# EasyEDA Pro project ProPrj_Starcat_FOC双路矢量控制器_2024-11-11.epro, board 双路大功率矢量控制器_3 (continued)
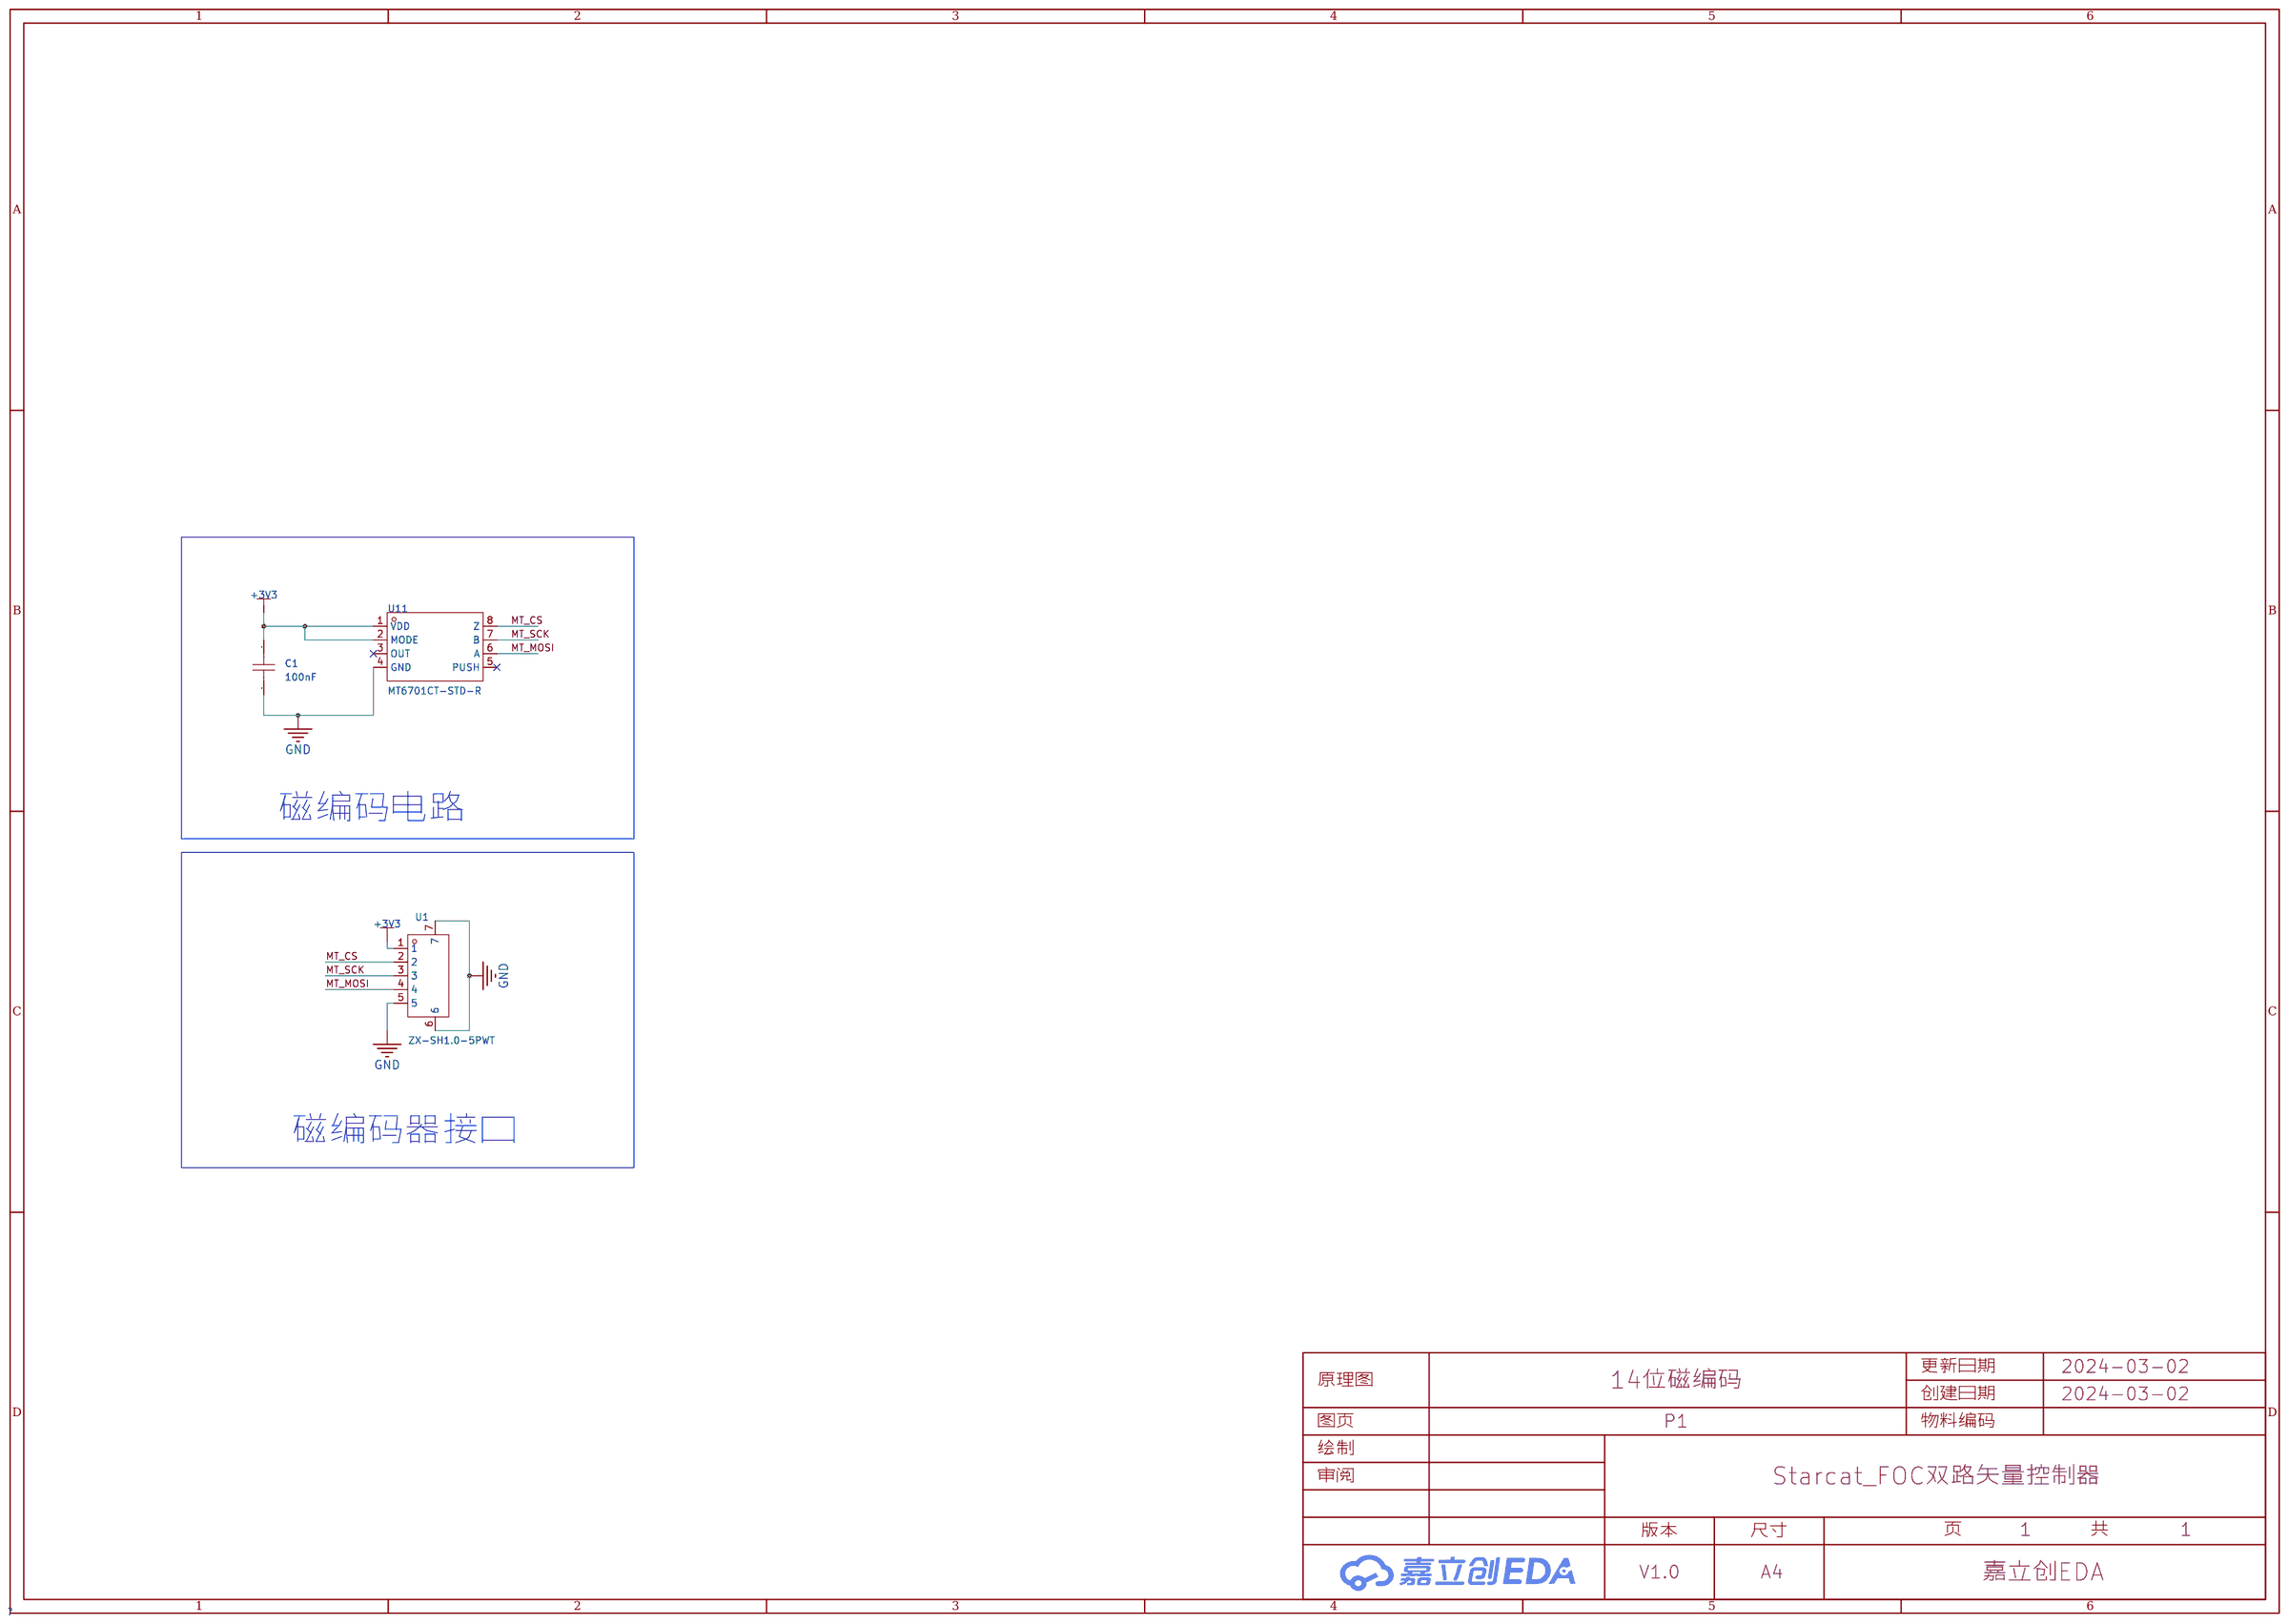
[diagram p0: schematic sheet]
## Routing (per net, layer and track width the routed paths; a pad name or vN(x,y) marks a point on that pad's centre or on a via; arc(x,y) is an arc through that point)
+3V3: length 368.2
  Top Layer w0.305: 48.6,42.16 48.34,42.16 47.75,41.57 v1(47.75,40.56) 47.5,40.3 U12.19 47.5,36.62 45.89,35.01 C10.1 ; 48.6,42.16 47.84,42.93 47.84,45.97 49.23,47.37 ; 48.6,42.16 49.23,42.16 49.61,41.78 52.23,41.78 52.45,41.57 52.45,40.85 52.79,40.51 53.68,40.51 54,40.2 U12.32 55.76,39.03 C8.1 ; C12.2 56,50.51 U12.48 53.56,48.53 52.41,47.37 49.23,47.37 ; C12.2 55.33,51.18 v1(54.82,51.18) ; C12.2 C9.1 57.74,49.97 v1(57.74,49.3) ; U12.1 v1(44.5,50.69) C11.1 44.87,50.53 U12.64 46.5,49.09 48.22,47.37 49.23,47.37 ; 49.74,54.6 49.74,54.99 49.36,55.37 v1(46.95,55.37) ; v1(77.72,9.94) 77.65,9.94 77.46,10.13 U11.1 ; v1(20.66,12.57) 20.66,13.09 U9.1 ; U16.49 32.24,41.93 32.6,42.29 v1(33.36,42.29) ; v1(75.65,43.49) 74.61,42.45 U15.49 74.61,39.65 77.55,36.7 79.21,36.7 80.97,34.94 80.97,32.57 81.28,32.27 84.87,32.27 85.17,32.57 85.17,33.52 v1(86.32,34.66) R1.2 ; v1(14.59,48.82) 14.59,51.59 16.52,53.51 C18.1 18.57,54.93 18.91,55.28 v1(19.9,55.28)
  Inner1 w0.305: v1(47.75,40.56) 46.57,39.37 45.3,39.37 43.67,40.99 33.77,40.99 33.36,41.4 v1(33.36,42.29) ; U11.1 77.46,14 79.59,16.13 79.59,16.53 81.62,18.56 81.62,27.81 80.98,28.45 80.22,28.45 79.08,29.59 79.08,31.88 v1(79.21,32) 79.84,32.64 81.62,32.64 81.83,32.85 81.83,36.23 81.24,36.83 76.41,36.83 75.65,37.59 v1(75.65,43.49)
  Inner2 w0.305: v1(46.95,55.37) 46.82,55.24 46.82,52.07 47.71,51.18 v1(54.82,51.18) ; v1(71.44,55.37) 71.44,49 70.67,48.23 58.81,48.23 v1(57.74,49.3) ; v1(77.72,9.94) 57.33,9.94 54.95,12.32 48.22,12.32 46.06,10.16 27.9,10.16 25.48,12.57 v1(20.66,12.57) ; v1(44.5,50.69) 43.75,51.43 33.49,51.43 32.34,52.58 v1(31.45,52.58) 31.33,52.58 30.95,52.96 30.95,54.61 30.28,55.28 v1(19.9,55.28)
  Bottom Layer w0.305: v1(77.72,9.94) 78.02,9.64 ; U4.5 21.55,54.99 21.13,55.41 21.01,55.28 v1(19.9,55.28) ; 80.48,9.66 R17.2 R16.2 ; R8.1 84.41,20.95 83.52,21.84 83.52,29.84 83.78,30.1 ; v1(54.82,51.18) 51.87,51.18 51.82,51.13 CN1.4 ; 83.78,30.1 86.83,30.1 87.33,29.59 87.33,27.68 R3.1 ; 83.78,30.1 83.52,30.35 83.52,31.32 82.58,32.26 79.46,32.26 v1(79.21,32) 78.63,31.43 72.79,31.43 72.09,32.13 72.09,34.16 72.34,34.41 C23.2 C22.1 ; v1(71.44,55.37) Q1.2 71.44,47.31 71.66,47.1 74.78,47.1 75.65,46.23 v1(75.65,43.49) U10.4 ; 85.96,20.95 85.96,17.46 86.57,16.85 87.35,16.85 87.57,16.63 87.57,15.86 87.52,15.81 ; CN2.4 14.59,46.48 v1(14.59,48.82) ; R14.2 24.86,9.53 25.23,9.91 ; 87.56,15.77 87.56,14.21 87.01,13.65 82.5,13.65 81.98,13.12 81.98,10.2 81.55,9.78 80.59,9.78 ; R12.2 20.66,10.3 v1(20.66,12.57)
  Bottom Layer w0.508: 21.64,9.53 23.67,9.53
  Bottom Layer w0.61: C5.2 68.38,51.72 68.92,51.18 71.12,51.18 Q1.2
+3V3_VDA: length 5.8
  Top Layer w0.305: U12.13 43.5,42.53 43.14,42.16 43.14,41.2 C3.1 41.68,39.74 L3.2
+3V3A: length 102.8
  Top Layer w0.305: v1(23.73,45.47) 23.73,46.73 24.19,47.18 24.19,48.02 U16.24 ; L3.1 38.95,39.8 C2.1 v1(37.55,39.55) 37.55,39.37 41.87,35.05 v1(41.87,33.53) ; R21.2 v1(67.01,30.23) ; 66.6,48.17 66.6,49.73 ; 66.78,49.89 v1(66.78,49.92)
  Inner1 w0.305: v1(56.35,33.65) 56.09,33.91 53.55,33.91 53.17,33.53 v1(41.87,33.53) 36.79,33.53 35.61,32.35 v1(35.61,30.23)
  Inner2 w0.305: v1(56.35,33.65) 65.87,33.65 67.01,32.52 v1(67.01,30.23) ; v1(23.73,45.47) 23.73,41.12 25.31,39.55 v1(37.55,39.55)
  Bottom Layer w0.305: 62.28,51.18 61.55,51.18 61,51.73 C6.2 ; 62.61,50.07 62.36,50.31 62.36,51.13 ; 62.61,50.07 62.35,49.82 v1(62.35,48.95) 61.16,47.75 57.49,47.75 54.31,44.58 54.31,34.16 54.69,33.78 56.22,33.78 v1(56.35,33.65) ; 62.61,50.07 62.79,49.88 66.73,49.88 ; 62.3,51.19 U1.5
+5V: length 173.9
  Top Layer w0.61: v1(68.41,50.55) 68.41,53.97 68.92,54.48 v1(73.62,54.48)
  Top Layer w0.762: 85.47,36.95 86.97,36.95 87.71,37.69 87.71,42.51 86.76,43.46 84.09,43.46 82.64,44.91 ; v1(80.56,47.44) 80.56,47.44 80.37,47.64 80.37,45.38 ; v1(49.18,11.21) 49.21,11.17 v1(49.21,10.31)
  Inner1 w0.762: v1(12.28,34.54) 12.28,18.16 20.53,9.91 48.81,9.91 v1(49.21,10.31) 49.21,10.47 49.48,10.73 ; 50.07,10.79 81.95,10.79 ; 81.95,10.79 82.35,11.19 ; 82.69,11.53 82.69,36.13 83.49,36.92 v1(85.44,36.92) 85.45,36.94 v1(86.31,36.94) ; v1(49.18,11.21) 49.6,10.79 49.91,10.79
  Bottom Layer w0.305: 73.16,54.44 Q1.3 ; L5.2 77.92,52.01 U6.4 ; v1(77.99,52.12) 78.82,52.96 78.82,53.59 79.14,53.91 U6.6
  Bottom Layer w0.61: v1(80.56,47.44) 78.91,47.44 77.99,48.36 v1(77.99,52.12) ; U1.1 62.38,53.02 62.57,52.83 63.97,52.83 64.28,53.15 U1.3 64.36,53.8 65.27,53.8 65.34,53.74 65.43,53.74 C1.2 67.18,53.19 67.39,52.98 67.39,51.56 v1(68.41,50.55) ; 73.24,54.36 73.37,54.48 v1(73.62,54.48) 75.45,54.48 C19.2 76.2,54.57 76.54,54.23 76.54,52.83 77.25,52.12 L5.2
  Bottom Layer w0.762: v1(12.28,34.54) D1.2
+9V: length 13.1
  Bottom Layer w0.305: 81.14,50.54 81.14,49.56 81,49.42 ; R11.2 82.16,50.61 C21.2 81.07,51.36 81.11,51.4 81.11,52.7 80.86,52.96 U6.5 ; 81.05,49.3 81.05,48.15 81.38,47.82 81.38,45.67 80.62,44.91 78.06,44.91 U10.2
AGND: length 581.7
  Top Layer w0.305: v1(41.74,55.5) 45.68,55.5 46.58,54.6 48.73,54.6 ; U11.5 81.46,10.83 U11.6 ; U16.28 22.24,48.33 19.94,50.63 C17.1 19.97,52.47 C18.2 20.09,53.64 ; v1(60.79,54.61) 59.27,54.61 58.89,54.23 C14.1 58.83,52.07 C9.2 C12.1 55.85,54.35 v1(54.82,55.37) ; 67.14,52.26 67.14,53.25 C66.1 v1(67.38,54.61) ; 85.3,47.5 85.3,51.56 84.55,52.32 84.03,52.32 ; U9.5 24.65,10.23 25.81,9.08 v1(25.81,9.03) 25.11,9.03 24.85,8.76 20.66,8.76 19.73,9.7 v1(19.55,9.7) ; 85.43,35.81 87.71,35.81 88.09,35.44 ; 85.43,35.81 85.43,35.94 84.67,36.7 84.67,37.46 v1(83.14,38.99) C47.2 ; 85.43,35.81 85.17,35.56 85.17,34.81 C49.1 ; 78.82,53.21 77.3,53.21 76.92,52.83 R31.2 ; 78.82,53.21 84.03,53.21 v1(84.16,53.09) 84.16,52.44 84.03,52.32 ; 78.82,53.21 79.24,52.79 R29.1 80.28,52.32 C46.1 ; v1(41.74,50.77) 41.74,49.61 C15.2 41.66,49.66 37.17,49.66 36.66,49.15 36.66,42.93 37.04,42.54 39.06,42.54 ; 29.68,52.26 29.99,51.94 33.58,51.94 R30.2 33.75,53.46 ; 35.24,42.16 36.54,42.16 37.5,41.2 C2.2 37.56,41.21 L4.1 39.06,41.3 39.06,42.54 ; 35.24,42.16 34.13,43.27 v1(31.28,43.27) ; 35.24,42.16 U16.55 ; 84.03,52.32 83.92,52.21 82.93,52.21 ; U12.18 47,36.88 44.92,34.8 44.92,33.4 45.3,33.02 45.83,33.02 C10.2 C36.1 47.03,33.08 R25.1 48.3,32.05 48.73,31.62 50.5,31.62 50.84,31.96 C34.1 51.59,33.08 51.6,33.08 R23.1 R24.1 ; 24.44,55.4 28.76,55.4 29.55,54.61 C56.1 ; 24.44,55.4 21,55.4 v1(20.09,54.48) 20.09,54.47 20.09,53.64 ; 24.44,55.4 24.91,54.93 C67.1 24.91,52.45 C63.2 ; 20.09,53.64 20.09,53.47 C73.1 21.14,53.3 C69.1 ; U15.28 64.21,47.95 62.33,49.83 62.33,51.86 62.73,52.26 63.44,52.26 63.44,53.47 C70.1 ; 33.75,53.46 33.49,53.72 v1(32,53.72) ; 33.75,53.46 33.87,53.34 41.1,53.34 42.24,52.19 C11.2 45.36,52.19 45.36,52.2 46.69,52.2 47,51.89 U12.63 ; C48.2 83.44,33.08 83.65,33.29 v1(83.65,33.63) ; 12.49,35.94 12.49,35.86 13.8,34.56 13.8,32.56 14.11,32.26 v1(16.59,32.26) ; v1(56.39,39.8) 57.54,39.8 C13.1 ; 39.06,42.54 41.17,42.54 C16.2
  Top Layer w0.61: R31.2 76.28,52.96 v1(75.65,52.96) 75.58,53.02 C54.1 ; 19.07,39.25 23.09,43.27 v1(26.71,43.27) ; 19.07,39.25 v1(19.07,41.11) 17.75,41.11 ; 19.07,39.25 19.07,36.64 16.59,34.16 v1(16.59,32.26) ; 17.78,47.5 19.15,47.5 v1(19.16,47.51) ; LED1.1 88.09,35.72 88.73,36.36 88.73,43.43 86.68,45.48 v1(85.67,45.48) 85.67,47.13 85.05,47.75 C51.1
  Top Layer w0.762: 20.4,32.3 20.4,33.06 C74.2 ; 20.4,32.3 20.36,32.26 v1(19.01,32.26) v1(18.37,32.26) ; 20.4,32.3 L1.1
  Inner1 w0.305: v1(83.14,38.99) 77.68,38.99 76.92,39.75 76.92,43.81 76.16,44.58 75.27,44.58 74.89,44.2 74.89,40.89 73.74,39.75 56.44,39.75 v1(56.39,39.8) 56.39,36.15 58.64,33.9 v1(58.64,33) v1(54.65,33) ; v1(60.79,54.61) 60.79,53.85 60.41,53.47 56.73,53.47 v1(54.82,55.37) 54.69,55.5 52.03,55.5 50.25,53.72 42.38,53.72 41.74,54.36 v1(41.74,55.5) 32.72,55.5 32.09,54.86 32.09,53.81 v1(32,53.72) ; v1(67.38,54.61) 67.38,53.87 67.88,53.37 75.24,53.37 v1(75.65,52.96) ; v1(84.16,53.09) 84,52.93 79.77,52.93 79.23,52.38 79.23,48.7
  Inner1 w0.61: v1(20.09,54.48) 18.88,53.28 18.88,47.78 v1(19.16,47.51) ; v1(73.62,45.21) 73.89,45.48 v1(85.67,45.48)
  Inner1 w0.762: v1(83.65,33.63) 83.65,10.79 v1(82.56,9.7) 81.9,9.04 v1(76.3,9.04) 76.28,9.02 v1(51.66,9.02) 25.81,9.02 v1(25.81,9.03) ; 51.65,9.07 51.65,9.63
  Inner2 w0.305: v1(60.79,54.61) 62.82,54.61 63.2,54.23 v1(63.2,49.02)
  Inner2 w0.61: v1(19.16,47.51) 19.16,41.2 v1(19.07,41.11)
  Bottom Layer w0.305: v1(60.79,54.61) 60.92,54.48 C6.1 61.3,54.48 61.81,54.99 63.58,54.99 ; v1(20.09,54.48) 20.15,54.42 20.15,54.1 19.77,53.72 U4.3 ; 11.85,44.84 CN2.5 ; 11.85,44.84 11.87,44.82 CN2.3 ; 11.85,44.84 CN2.6 ; 15.71,44.92 15.78,44.85 16.32,44.85 16.64,45.17 16.64,45.99 16.26,46.38 15.83,46.38 15.48,46.73 15.48,51.59 17.72,53.83 17.92,53.83 ; SW1.2 89.75,24.23 89.75,26.98 89.01,27.72 NRST.2 89.01,31.29 86.67,33.63 v1(83.65,33.63) 82.92,32.9 R19.1 76.06,32.9 75.95,33.01 C22.2 C23.1 ; v1(16.59,32.26) v1(18.37,32.26) ; 79.67,49.45 79.72,49.5 79.72,50.61 ; 75.52,53.15 75.52,53.15 C4.1 ; v1(58.64,33) 58.64,35.31 61.22,37.89 U10.12 ; U10.5 74.26,42.79 v1(73.62,43.43) ; R15.1 86.29,50.66 84.16,52.79 v1(84.16,53.09) 82.39,53.09 U6.2 ; CN1.1 45.73,51.13 45.3,51.56 42.53,51.56 v1(41.74,50.77) v1(41.74,55.5) ; 88.9,18.33 88.92,18.35 88.98,24.26 88.48,24.76 85.17,24.76 84.86,25.08 C7.1 ; Q1.1 69.58,54.57 C5.1 68.36,54.59 C1.1 65.58,54.99 63.58,54.99 ; 88.99,18.29 88.99,14.67 87.43,13.11 82.94,13.11 82.58,12.75 82.58,9.72 ; 63.58,54.99 63.33,54.74 U1.2 ; 79.67,49.19 79.13,48.65 79.06,48.65
  Bottom Layer w0.61: C19.1 75.52,53.15
  vias: v1(26.71,45.26) v1(26.71,44.33) v1(27.47,45.26) v1(27.47,44.33) v1(27.47,43.27) v1(28.24,45.26) v1(28.24,44.33) v1(28.24,43.27) v1(29,45.26) v1(29,44.33) v1(29,43.27) v1(29.76,45.26) v1(29.76,44.33) v1(29.76,43.27) v1(30.52,45.26) v1(30.52,44.33) v1(30.52,43.27) v1(31.28,45.26) v1(31.28,44.33) v1(51.67,9.65) v1(69.05,45.21) v1(69.04,44.34) v1(69.05,43.43) v1(69.8,45.21) v1(69.8,44.34) v1(69.81,43.43) v1(70.57,45.21) v1(70.57,44.34) v1(70.57,43.43) v1(71.33,45.21) v1(71.32,44.34) v1(71.33,43.43) v1(72.09,45.21) v1(72.09,43.43) v1(72.1,44.34) v1(72.85,45.21) v1(72.86,44.34) v1(72.85,43.43) v1(73.63,44.34) v1(79.16,48.59) v1(83.72,47.75)
GND_VDA: length 5.2
  Top Layer w0.305: L4.2 41.73,41.21 C3.2 42.63,42.09 42.63,42.67 42.98,43.03 U12.12
PGND: length 211.4
  Top Layer w0.305: v1(24.99,31.89) 24.99,32.82 C65.1 24.66,33.08 23.96,33.78 23.96,35.18 23.74,35.4 U16.32 ; v1(22.07,31.88) 22.07,32.88 21.3,33.65 21.3,35.05 ; U16.30 22.74,36.5 21.33,35.09 ; U15.32 66.11,38.46 62.44,34.8 62.44,33.4 62.76,33.08 C64.1 v1(63.46,32.13) ; U15.30 65.11,40.53 65.11,38.99 62.06,35.94 60.28,35.94 59.52,35.18 59.52,33.4 59.84,33.08 C72.1 v1(60.29,32.13) ; U16.44 29.74,38.8 31.07,37.46 34.12,37.46 36.5,35.08 v1(36.5,32.26) ; v1(75.97,32.13) 75.97,34.99 72.11,38.85 U15.44
  Top Layer w0.762: 16.34,20.19 19.64,20.19 20.4,20.95 20.4,22.96
  Inner1 w0.305: v1(25,18.15) 21.94,18.15 21.17,18.92 21.17,30.83 22.07,31.73 v1(22.07,31.88) ; v1(63.77,18.23) 60.59,18.23 59.77,19.05 59.77,24.13 61.4,25.75 61.4,30.45 62.31,31.37 63.2,31.37 63.46,31.62 v1(63.46,32.13) ; v1(75.97,32.13) 75.97,31.43 76.92,30.48 76.92,23.75 76.21,23.04 v1(72.68,23.04) ; v1(54.19,18.03) 53.76,18.03 52.89,18.9 50.97,18.9 50.35,19.52 50.35,30.58 51.52,31.75 59.91,31.75 v1(60.29,32.13) ; v1(24.99,31.89) 24.99,31.1 25.99,30.1 28.61,30.1 28.91,29.79 28.91,19.43 30.08,18.26 34.26,18.26 v1(34.37,18.15) ; v1(41.71,23) 41.74,23.04 41.74,32 41,32.74 36.81,32.74 36.5,32.44 v1(36.5,32.26)
  Bottom Layer w0.305: v1(54.19,18.03) 55.71,19.56 R53.1 ; v1(63.77,18.23) 65.1,19.56 R52.1 ; R54.1 37.42,19.68 35.88,18.15 v1(34.37,18.15) ; R55.1 26.41,19.68 25.66,18.93 25.66,18.85 25.3,18.49 25.3,18.45 v1(25,18.15)
  Bottom Layer w0.762: 10.12,21.21 10.63,21.72 C33.1 14.6,21.72 CN3.1
  vias: v1(41.74,21.91) v1(41.8,20.64) v1(42.06,22.46) v1(42.01,21.32) v1(42.14,20.04) v1(42.36,23.02) v1(42.43,21.91) v1(42.47,20.65) v1(42.64,21.33) v1(42.7,22.48) v1(42.83,20.01) v1(42.99,23.02) v1(43.09,21.89) v1(43.12,20.63) v1(43.28,21.27) v1(43.35,22.48) v1(43.55,20.03) v1(43.64,23.03) v1(43.71,21.88) v1(43.8,20.62) v1(43.95,22.49) v1(43.92,21.26) v1(70.75,23.02) v1(70.78,21.93) v1(70.84,20.65) v1(71.05,21.33) v1(71.1,22.48) v1(71.18,20.05) v1(71.4,23.03) v1(71.47,21.93) v1(71.51,20.66) v1(71.68,21.34) v1(71.74,22.49) v1(71.87,20.02) v1(72.04,23.03) v1(72.13,21.9) v1(72.16,20.64) v1(72.39,22.49) v1(72.32,21.28) v1(72.59,20.04) v1(72.75,21.89) v1(72.84,20.63) v1(72.96,21.27) v1(73,22.5)
VBUS_5V: length 20.4
  Top Layer w0.61: 17.75,41.92 20.12,41.92 v1(20.13,41.94) ; 17.81,46.68 20.12,46.68 v1(20.13,46.69)
  Bottom Layer w0.61: v1(12.61,37.21) 14.26,38.86 19.39,38.86 20.15,39.62 20.15,46.74
AH_1: length 20
  Top Layer w0.305: v1(69.97,49.66) 69.97,49.62 70.11,49.49 U15.17 ; v1(59.64,43.78) 58.4,45.03 U12.41
  Inner1 w0.305: v1(69.97,49.66) 69.97,47.54 69.68,47.24 62.95,47.24 59.64,43.94 v1(59.64,43.78)
AH_2: length 34
  Top Layer w0.305: v1(33.23,43.88) 33.23,46.35 32.85,46.74 27.9,46.74 27.74,46.89 U16.17 ; U12.37 53.07,43.03 52.79,43.31 50.37,43.31 v1(50.24,43.18)
  Bottom Layer w0.305: v1(50.24,43.18) 48.5,41.44 35.67,41.44 v1(33.23,43.88)
AL_1: length 16.9
  Top Layer w0.305: U15.18 69.61,46.91 68.92,46.23 68.1,46.23 67.72,45.85 64.22,45.85 59.9,41.53 57.3,41.53 57.3,41.53 U12.34
AL_2: length 32.4
  Top Layer w0.305: U16.18 27.24,49.04 v1(26.88,49.4) ; v1(48.65,40.59) 49.28,40.59 49.45,40.42 49.45,39.07 U12.23
  Inner2 w0.305: v1(48.65,40.59) 48.65,40.84 48.22,41.27 35.26,41.27 34.12,42.42 34.12,46.74 33.87,46.99 28.41,46.99 27.17,48.22 27.17,49.11 v1(26.88,49.4)
AO_1: length 17.2
  Top Layer w0.305: 77.92,33.86 79.36,33.86 79.94,33.27 79.94,33.2 ; 77.92,33.86 77.89,33.86 77.64,34.1 77.64,35.09 77.43,35.31 77.05,35.31 73.11,39.25 U15.46 ; 77.92,33.86 77.92,33.86 77.92,33.87 ; C52.2 80.1,31.76 79.08,30.73 79.08,27.56
AO_2: length 27.8
  Top Layer w0.305: U16.46 30.74,39.12 31.47,38.39 34.97,38.39 38.12,35.24 38.12,34.04 38.28,33.88 40.04,33.88 40.49,33.43 ; 50.63,27.43 50.63,29.21 49.11,30.73 43.12,30.73 40.66,33.19 C53.2
BH_1: length 18.2
  Top Layer w0.305: U12.42 58.76,45.53 v1(59.56,44.72) ; v1(69.15,49.64) 69.11,49.6 U15.19
  Inner1 w0.305: v1(59.56,44.72) 59.66,44.72 62.7,47.75 68.92,47.75 69.15,47.99 v1(69.15,49.64)
BH_2: length 34.2
  Top Layer w0.305: v1(49.35,43.3) 49.84,43.79 53.13,43.79 53.39,43.53 U12.38 ; U16.19 26.74,46.88 27.32,46.29 32.4,46.29 32.6,46.1 v1(32.6,44.7)
  Bottom Layer w0.305: v1(49.35,43.3) 47.97,41.91 36.15,41.91 33.36,44.7 v1(32.6,44.7)
BL_1: length 15.7
  Top Layer w0.305: U12.35 59.51,42.03 63.87,46.38 67.68,46.38 67.93,46.63 68.31,46.63 68.61,46.93 U15.20
BL_2: length 36.5
  Top Layer w0.305: U12.26 51,40.53 50.25,41.28 v1(49.2,41.28) ; U16.20 26.24,49.96 v1(26.33,50.06)
  Inner2 w0.305: v1(49.2,41.28) 49.2,41.59 49.03,41.76 35.42,41.76 34.63,42.54 34.63,47.24 34.37,47.5 28.66,47.5 27.58,48.58 27.58,50.16 27.23,50.51 26.59,50.51 26.33,50.25 v1(26.33,50.06)
BO_1: length 19.8
  Top Layer w0.305: 74.96,33.29 74.45,33.79 72.98,33.79 72.73,34.04 72.73,35.51 70.61,37.64 U15.41 ; C55.2 75.15,31.12 74.38,30.35 70.82,30.35 70.19,29.72 70.19,27.56 70.06,27.43
BO_2: length 22.3
  Top Layer w0.305: 35.47,33.39 35.03,33.84 33.43,33.84 33.18,34.08 33.18,35.23 32.23,36.18 30.58,36.18 28.24,38.52 U16.41 ; C57.2 35.66,31.78 35.96,31.48 39.85,31.48 40.6,30.73 40.6,27.43
CAN_H: length 40.1
  Bottom Layer w0.305: v1(26.08,53.72) 27.01,53.72 28.21,52.52 28.21,49.72 29.04,48.89 35.24,48.89 37.55,51.21 37.55,52.07 38.06,52.58 39.07,52.58 39.32,52.33 U7.2 39.32,50.43 39.77,49.98 47.77,49.98 48.18,49.57 56.26,49.57 57.12,50.43 U8.1
CAN_L: length 38.8
  Bottom Layer w0.305: U8.2 58.12,51.12 58.12,50.16 57.87,49.91 57.36,49.91 56.6,49.15 47.96,49.15 47.56,49.55 39.26,49.55 38.32,50.49 38.32,50.92 ; 38.32,50.92 U7.1 ; 38.32,50.92 38.18,51.05 35.52,48.39 28.79,48.39 27.77,49.4 27.77,51.69 27.05,52.41 26.12,52.41 v1(26.08,52.45)
CAN_RX: length 22.1
  Top Layer w0.305: U12.61 48,52.29 45.7,54.58 34.68,54.58 34.37,54.28 v1(34.37,54.23)
  Bottom Layer w0.305: v1(34.37,54.23) 33.36,54.23 33.1,53.97 33.1,51.56 32.72,51.18 U5.4
CAN_TX: length 18.9
  Top Layer w0.305: U12.62 47.5,52.16 45.8,53.85 35.39,53.85 v1(35.26,53.97)
  Bottom Layer w0.305: U5.1 34.25,54.99 34.4,54.84 34.63,54.84 34.98,54.48 34.98,54.25 v1(35.26,53.97)
CH_1: length 16.5
  Top Layer w0.305: v1(59.61,45.53) 59.12,46.03 U12.43 ; U15.21 68.11,49.61 v1(68.16,49.66)
  Inner1 w0.305: v1(68.16,49.66) 68.16,48.51 67.9,48.26 62.31,48.26 59.61,45.56 v1(59.61,45.53)
CH_2: length 35.6
  Top Layer w0.305: U16.21 25.74,45.99 v1(25.62,45.87) ; U12.39 53.47,44.03 53.16,44.33 49.47,44.33 v1(48.57,43.43)
  Bottom Layer w0.305: v1(25.62,45.87) 26.23,46.48 32.34,46.48 36.51,42.32 47.46,42.32 v1(48.57,43.43)
CL_1: length 14.4
  Top Layer w0.305: U12.36 59.25,42.53 63.51,46.79 67.33,46.79 67.63,47.1 67.63,47.93 U15.22
CL_2: length 38.6
  Top Layer w0.305: v1(25.63,50.44) 25.24,50.05 U16.22 ; U12.27 51.5,40.02 v1(51.96,40.48)
  Inner2 w0.305: v1(51.96,40.48) 51.68,40.48 50,42.16 35.65,42.16 35.11,42.71 35.11,47.37 34.48,48.01 28.91,48.01 28.02,48.89 28.02,50.29 27.39,50.93 26.12,50.93 v1(25.63,50.44)
CO_1: length 22.1
  Top Layer w0.305: 60.92,27.3 60.92,28.96 61.3,29.34 67.14,29.34 67.78,29.97 67.78,30.75 70.1,33.08 C60.2 ; 69.92,33.31 69.44,33.79 68.05,33.79 67.78,34.06 67.78,36.32 68.11,36.65 U15.36
CO_2: length 17
  Top Layer w0.305: 30.34,33.37 29.86,33.84 28.04,33.84 27.9,33.98 27.9,35.07 25.74,37.23 U16.36 ; 31.82,27.29 31.78,27.29 ; 31.82,27.29 31.84,27.27 ; 31.82,27.29 31.81,27.3 31.81,29 ; 30.31,33.16 30.31,31.09 31.81,29.59 31.81,29 ; 31.81,29 31.81,28.82
CS_ENC_A_1: length 67.1
  Top Layer w0.305: v1(51.27,48.13) 50.5,48.9 U12.56 ; v1(78.47,11.81) 78.47,12.65 ; v1(79.69,29.93) 81.27,28.35 81.27,17.82 78.46,15 U11.2
  Inner2 w0.305: v1(79.69,29.93) 68.83,29.93 67.52,31.24 67.52,36.32 66,37.85 54.69,37.85 54.19,38.35 54.19,47.5 53.55,48.13 v1(51.27,48.13)
  Bottom Layer w0.305: 78.44,11.17 78.45,11.16 78.46,11.16 ; 78.47,11.22 v1(78.47,11.81)
CS_ENC_A_2: length 72.3
  Top Layer w0.305: v1(49.5,48.13) U12.58 ; U9.2 21.65,11.16
  Inner1 w0.305: v1(21.64,11.03) 21.64,13.25 19.01,15.87 19.01,30.61 19.64,31.24 19.64,37.46 20.66,38.48 v1(40.47,38.48) ; v1(51.14,42.67) 51.14,46.48 49.5,48.12 v1(49.5,48.13)
  Bottom Layer w0.305: v1(40.47,38.48) 47.71,38.48 51.14,41.91 v1(51.14,42.67)
D+: length 13.8
  Top Layer w0.305: USB1.B6 16.58,43.57 16.34,43.81 16.34,44.09 ; 16.34,44.09 16.34,44.32 16.59,44.58 17.74,44.58 USB1.A6 ; 16.34,44.09 15.81,44.09 15.2,44.7 15.2,50.04 16.34,51.18 v1(17.74,51.18)
  Bottom Layer w0.305: v1(17.74,51.18) U4.1
D-: length 14.8
  Top Layer w0.305: USB1.A7 19.06,44.07 19.39,44.4 19.39,44.7 19.02,45.07 USB1.B7 ; 19.41,44.55 20.45,44.55 21,45.1 21,47.54 19.71,48.82 v1(19.69,48.82)
  Bottom Layer w0.305: v1(19.69,48.82) 19.6,48.91 19.6,52.03 19.21,52.41 18.23,52.41
DCBUS: length 77
  Top Layer w0.305: 16.17,27.35 17.61,28.79 17.61,33.53 18.5,34.42 20.36,34.42 C74.1 20.42,35.07 22.24,36.89 U16.29 ; v1(49.61,32.38) 49.57,32.43 R20.2 ; v1(56.97,28.65) 56.97,33.64 57.8,34.48 C71.1 58.64,35.06 60.16,36.58 61.66,36.58 64.61,39.52 U15.29
  Top Layer w0.762: 81.75,35.56 81.75,35.68 81.86,35.79 81.13,35.79 v1(81.12,35.8) ; 81.75,35.56 82,35.81 83.74,35.81 ; 81.75,35.56 81.75,34.7 ; 83.61,35.68 83.74,35.81 ; 83.74,35.81 83.9,35.81 84.05,35.67 ; 83.74,35.81 83.83,35.9 83.84,36.95 82.8,38 77.78,38 76.84,38.95 76.84,41
  Inner1 w0.762: v1(81.12,35.8) 76.32,35.8 74.89,34.36 74.89,27.95 75.28,27.55
  Bottom Layer w0.305: 46.53,28.67 46.57,28.7 49.11,28.7 49.61,29.21 v1(49.61,32.38)
  Bottom Layer w0.762: D2.2 10.79,25.62 R2.2 14.44,25.62 16.17,27.35
  vias: v1(24.48,27.35) v1(24.58,26.05) v1(24.5,24.74) v1(24.66,28.61) v1(24.85,26.76) v1(25,28.05) v1(25.06,25.38) v1(25.23,27.39) v1(25.23,24.72) v1(25.31,28.62) v1(25.3,26.06) v1(25.65,28.04) v1(25.63,26.72) v1(25.78,25.38) v1(25.96,28.62) v1(25.96,27.4) v1(26.03,26.03) v1(26.02,24.7) v1(26.31,28.05) v1(26.36,26.74) v1(26.52,25.31) v1(26.61,28.62) v1(26.63,27.4) v1(26.82,26) v1(26.88,24.68) v1(26.96,28.05) v1(27.03,26.72) v1(27.26,28.62) v1(27.27,25.3) v1(27.31,27.38) v1(27.57,26) v1(27.64,28.01) v1(27.63,24.7) v1(27.8,26.72) v1(27.92,28.61) v1(27.95,25.27) v1(28,27.43) v1(34.07,27.4) v1(34.17,26.1) v1(34.1,24.79) v1(34.26,28.66) v1(34.45,26.81) v1(34.59,28.1) v1(34.65,25.43) v1(34.83,27.45) v1(34.89,26.11) v1(34.82,24.77) v1(34.91,28.68) v1(35.25,28.1) v1(35.22,26.77) v1(35.37,25.43) v1(35.56,28.68) v1(35.55,27.46) v1(35.62,26.08) v1(35.61,24.75) v1(35.91,28.1) v1(35.95,26.8) v1(36.11,25.36) v1(36.21,28.68) v1(36.23,27.45) v1(36.41,26.06) v1(36.47,24.73) v1(36.55,28.1) v1(36.63,26.77) v1(36.86,28.68) v1(36.86,25.35) v1(36.91,27.43) v1(37.17,26.06) v1(37.23,28.07) v1(37.22,24.76) v1(37.39,26.77) v1(37.51,28.67) v1(37.59,27.48) v1(37.54,25.33) v1(43.49,27.36) v1(43.52,24.75) v1(43.68,28.63) v1(43.6,26.07) v1(43.87,26.78) v1(44.01,28.07) v1(44.08,25.39) v1(44.25,27.41) v1(44.25,24.74) v1(44.33,28.64) v1(44.31,26.08) v1(44.67,28.06) v1(44.64,26.74) v1(44.79,25.39) v1(44.98,28.64) v1(44.97,27.42) v1(45.05,26.05) v1(45.04,24.71) v1(45.33,28.07) v1(45.37,26.76) v1(45.53,25.32) v1(45.63,28.64) v1(45.65,27.42) v1(45.84,26.02) v1(45.89,24.7) v1(45.98,28.07) v1(46.05,26.73) v1(46.28,28.64) v1(46.28,25.31) v1(46.33,27.39) v1(46.59,26.02) v1(46.65,28.03) v1(46.64,24.72) v1(46.81,26.74) v1(46.93,28.63) v1(46.96,25.29) v1(47.01,27.44) v1(53.53,27.38) v1(53.56,24.77) v1(53.64,26.09) v1(53.72,28.65) v1(53.91,26.8) v1(54.05,28.09) v1(54.11,25.41) v1(54.29,27.43) v1(54.28,24.76) v1(54.37,28.66) v1(54.35,26.1) v1(54.68,26.76) v1(54.71,28.08) v1(54.83,25.41) v1(55.02,28.66) v1(55.01,27.44) v1(55.08,26.07) v1(55.07,24.73) v1(55.37,28.09) v1(55.41,26.78) v1(55.57,25.34) v1(55.67,28.66) v1(55.68,27.44) v1(55.87,26.04) v1(55.93,24.72) v1(56.01,28.09) v1(56.09,26.75) v1(56.32,28.66) v1(56.37,27.42) v1(56.32,25.33) v1(56.69,28.05) v1(56.63,26.04) v1(56.68,24.74) v1(56.85,26.76) v1(57.05,27.46) v1(57,25.31) v1(63.03,27.38) v1(63.06,24.77) v1(63.14,26.09) v1(63.22,28.65) v1(63.41,26.8) v1(63.55,28.09) v1(63.61,25.41) v1(63.79,27.43) v1(63.78,24.76) v1(63.87,28.66) v1(63.85,26.1) v1(64.18,26.76) v1(64.21,28.08) v1(64.33,25.41) v1(64.52,28.66) v1(64.51,27.44) v1(64.58,26.07) v1(64.57,24.73) v1(64.87,28.09) v1(64.91,26.78) v1(65.07,25.34) v1(65.17,28.66) v1(65.18,27.44) v1(65.37,26.04) v1(65.43,24.72) v1(65.51,28.09) v1(65.59,26.75) v1(65.82,28.66) v1(65.87,27.42) v1(65.82,25.33) v1(66.19,28.05) v1(66.13,26.04) v1(66.18,24.74) v1(66.35,26.76) v1(66.47,28.65) v1(66.55,27.46) v1(66.5,25.31) v1(72.53,27.38) v1(72.56,24.77) v1(72.64,26.09) v1(72.72,28.65) v1(72.91,26.8) v1(73.05,28.09) v1(73.11,25.41) v1(73.29,27.43) v1(73.28,24.76) v1(73.37,28.66) v1(73.35,26.1) v1(73.68,26.76) v1(73.71,28.08) v1(73.83,25.41) v1(74.02,28.66) v1(74.01,27.44) v1(74.08,26.07) v1(74.07,24.73) v1(74.37,28.09) v1(74.41,26.78) v1(74.57,25.34) v1(74.67,28.66) v1(74.68,27.44) v1(74.87,26.04) v1(74.93,24.72) v1(75.01,28.09) v1(75.09,26.75) v1(75.32,28.66) v1(75.37,27.42) v1(75.32,25.33) v1(75.69,28.05) v1(75.63,26.04) v1(75.68,24.74) v1(75.85,26.76) v1(75.97,28.65) v1(76.05,27.46) v1(76,25.31)
EN_GATE: length 69.6
  Top Layer w0.305: v1(66.63,45.21) 64.47,45.21 60.29,41.03 U12.33 53.32,41.03 v1(53.2,41.15) ; 70.65,48.17 70.65,50.19 70.42,50.42 v1(69.84,50.42) ; v1(28.53,53.21) 27.64,53.21 26.94,52.51 26.94,50.31 27.5,49.75 27.93,49.75 28.24,49.44 U16.16
  Inner1 w0.305: v1(66.63,45.21) 66.63,45.97 67.5,46.84 70.42,46.84 70.79,47.21 70.79,50.08 70.44,50.42 v1(69.84,50.42)
  Inner2 w0.305: v1(53.2,41.15) 51.59,41.15 50.16,42.57 35.82,42.57 35.52,42.88 35.52,47.75 34.76,48.51 29.04,48.51 28.53,49.02 v1(28.53,53.21)
GH_A_1: length 8.2
  Top Layer w0.305: U15.47 73.6,40.53 73.6,39.46 77.34,35.71 77.67,35.71 78.32,35.06 78.32,34.54
GH_A_2: length 11.4
  Top Layer w0.305: U16.47 31.24,39.33 31.71,38.86 35.38,38.86 38.95,35.3 R43.1
GH_B_1: length 6.9
  Top Layer w0.305: U15.42 71.11,37.94 73.5,35.55 R41.1
GH_B_2: length 9.5
  Top Layer w0.305: U16.42 28.74,38.65 30.75,36.64 32.79,36.64 34.01,35.42 R44.1
GH_C_1: length 6
  Top Layer w0.305: U15.37 68.61,34.65 R42.1
GH_C_2: length 7.1
  Top Layer w0.305: U16.37 26.24,37.6 28.68,35.16 R45.1
GL_A_1: length 7.7
  Top Layer w0.305: U15.45 72.61,39.11 76.8,34.92 R51.1
GL_A_2: length 10.9
  Top Layer w0.305: U16.45 30.24,38.93 31.3,37.87 34.48,37.87 37.31,35.04 R48.1
GL_B_1: length 6.7
  Top Layer w0.305: R46.1 71.9,35.38 70.11,37.17 U15.40
GL_B_2: length 8.7
  Top Layer w0.305: U16.40 27.74,38.38 30.38,35.75 31.52,35.75 32.36,34.91 R49.1
GL_C_1: length 6.3
  Top Layer w0.305: U15.35 67.61,37.29 66.89,36.58 66.89,35.3 66.89,35.3 R47.1
GL_C_2: length 6.8
  Top Layer w0.305: 27.07,34.61 27.07,34.71 25.24,36.54 U16.35
LED1: length 9.3
  Top Layer w0.305: LED2.1 50.75,55.17 51.06,55.47 53.45,55.47 54.69,54.23 54.69,53.21 53.5,52.01 U12.50
MOSI_ENC_Z_1: length 56.4
  Top Layer w0.305: 80.46,12.76 80.42,12.73 v1(80.42,11.83) ; v1(57.62,43.18) 57.62,44.2 57.29,44.53 U12.40 ; U11.4 80.46,14.84 82.76,17.14 82.76,28.58 v1(81.39,29.95)
  Inner2 w0.305: v1(81.39,29.95) 80.23,31.11 69.81,31.11 69.05,31.88 69.05,36.96 66.89,39.12 59.14,39.12 57.62,40.64 v1(57.62,43.18)
  Bottom Layer w0.305: 80.4,11.2 80.42,11.22 v1(80.42,11.83)
MOSI_ENC_Z_2: length 76.3
  Top Layer w0.305: U12.4 v1(46.57,47.03) ; U9.4 23.65,11.05 v1(23.67,11.03)
  Inner1 w0.305: v1(41.99,37.08) 39.45,37.08 39.07,37.46 21.55,37.46 20.66,36.58 20.66,30.48 20.4,30.23 20.4,16.76 23.67,13.5 v1(23.67,11.03)
  Inner2 w0.305: v1(46.57,47.03) 48.05,47.03 49.49,45.59 v1(52.92,45.59)
  Bottom Layer w0.305: v1(41.99,37.08) 47.58,37.08 52.28,41.78 52.28,44.96 v1(52.92,45.59)
NFAULT_1: length 33.5
  Top Layer w0.305: v1(75.9,49.78) 75.61,49.49 U15.6 ; v1(52.28,54.86) 51.5,54.08 U12.54
  Inner1 w0.305: v1(75.9,49.78) 75.9,51.69 74.63,52.96 56.29,52.96 54.36,54.89 52.31,54.89 v1(52.28,54.86)
NFAULT_2: length 22.6
  Top Layer w0.305: v1(50.88,52.07) 51,51.96 U12.55 ; U16.6 33.24,49.54 33.6,49.9 35.38,49.9 v1(35.95,50.47)
  Inner1 w0.305: v1(50.88,52.07) 36.13,52.07 35.95,51.89 v1(35.95,50.47)
NRST: length 59.3
  Top Layer w0.305: U12.7 45.86,45.53 46.19,45.85 v1(46.19,46.23)
  Inner1 w0.305: v1(53.42,44.96) 54.31,44.07 58.38,44.07 v1(58.76,43.69)
  Inner2 w0.305: v1(84.89,29.08) 84.89,32.41 84.29,33.02 72.22,33.02 71.33,33.91 71.33,38.35 69.68,40 59.77,40 59.14,40.64 59.14,43.31 v1(58.76,43.69) ; v1(46.19,46.23) 46.31,46.35 47.96,46.35 49.36,44.96 v1(53.42,44.96)
  Bottom Layer w0.305: v1(84.89,29.08) 84.89,27.08 84.92,27.05 85.68,27.05 86.26,26.48 C7.2 R3.2
NSCS_1: length 46.7
  Top Layer w0.305: U15.8 74.61,50.87 v1(75.09,51.36) ; v1(46.44,48.01) 46.42,48.03 U12.2
  Inner1 w0.305: v1(75.09,51.36) 74.63,50.9 74.63,46.86 74.13,46.35 68.16,46.35 67.65,45.85 67.65,44.58 65.24,42.16 53.27,42.16 53.02,41.91 48.34,41.91 47.96,42.29 47.96,47.24 47.2,48.01 v1(46.44,48.01)
NSCS_2: length 18.6
  Top Layer w0.305: U12.3 43.24,47.53 43.01,47.75 43.01,51.05 42.69,51.38 33.05,51.38 32.24,50.57 U16.8
OLED_CS: length 27.3
  Top Layer w0.305: U12.44 59.59,46.53 v1(59.9,46.84)
  Bottom Layer w0.305: v1(59.9,46.84) 62.47,46.84 62.95,46.35 v1(62.95,41.39) U10.7
OLED_DC: length 30.6
  Top Layer w0.305: v1(55.33,35.61) 55,35.94 52.74,35.94 52,36.68 U12.28
  Bottom Layer w0.305: U10.9 60.49,39.99 56.24,35.74 55.79,35.74 55.66,35.61 v1(55.33,35.61)
OLED_RES: length 28
  Top Layer w0.305: U12.45 58.9,47.03 v1(59.01,47.14)
  Bottom Layer w0.305: U10.8 78.01,40.66 v1(62.22,40.66) 62.22,45.84 61.92,46.14 59.73,46.14 59.01,46.86 v1(59.01,47.14)
OLED_SCL: length 30.7
  Top Layer w0.305: v1(56.04,35.13) 56.04,36.14 55.84,36.35 53.14,36.35 52.5,37 U12.29
  Bottom Layer w0.305: v1(56.04,35.13) 56.55,35.13 60.79,39.37 77.96,39.37 78.04,39.29
OLED_SDA: length 30.9
  Top Layer w0.305: v1(56.71,34.43) 56.71,36.38 56.27,36.83 53.35,36.83 53,37.18 U12.30
  Bottom Layer w0.305: U10.11 60.88,38.59 v1(56.71,34.43)
OSC_IN: length 7.9
  Top Layer w0.305: C15.1 41.72,47.12 R6.2 ; R6.2 42.35,46.48 44.83,46.48 ; R6.2 41.47,46.86 40.08,46.86 X1.2
OSC_OUT: length 8
  Top Layer w0.305: R6.1 41.73,45.59 C16.1 ; R6.1 42.14,46.03 U12.6 ; R6.1 39.85,45.61 38.89,44.64 X1.1
RX: length 51.2
  Top Layer w0.305: U12.15 45.81,41.53 46.06,41.27 46.06,40.39 v1(45.68,40)
  Inner1 w0.305: v1(13.67,42.8) 21.42,42.8 v1(21.55,42.93)
  Bottom Layer w0.305: v1(13.67,42.8) 15.22,42.8 CN2.1 ; U4.6 22.31,53.72 21.55,52.96 v1(21.55,42.93) 21.55,41.4 22.79,40.15 45.53,40.15 v1(45.68,40)
SCK_ENC_B_1: length 69.3
  Top Layer w0.305: U11.3 79.46,14.99 82.13,17.65 82.13,28.36 v1(80.54,29.94) ; U12.57 50,48.51 v1(50.38,48.13) ; v1(79.47,11.81) 79.47,12.7 79.52,12.74
  Inner2 w0.305: v1(50.38,48.13) 50.38,48.26 50.88,48.77 53.81,48.77 54.82,47.75 54.82,38.86 55.2,38.48 66.63,38.48 68.54,36.58 68.54,31.24 69.07,30.71 79.77,30.71 v1(80.54,29.94)
  Bottom Layer w0.305: 79.48,11.25 79.48,11.8 v1(79.47,11.81)
SCK_ENC_B_2: length 77.9
  Top Layer w0.305: v1(48.6,48.13) 49,48.53 U12.59 ; U9.3 v1(22.65,11.03)
  Inner1 w0.305: v1(22.65,11.03) 22.65,13.25 19.64,16.26 19.64,30.35 20.15,30.86 20.15,37.08 21.04,37.97 39.71,37.97 39.84,37.85 v1(41.23,37.85)
  Inner2 w0.305: v1(48.6,48.13) 48.6,47.37 49.87,46.1 52.44,46.1 52.54,46.2 53.17,46.2 53.19,46.23 v1(53.58,46.23)
  Bottom Layer w0.305: v1(41.23,37.85) 47.75,37.85 51.87,41.97 51.87,45.54 52.56,46.23 v1(53.58,46.23)
SERVO0: length 39
  Top Layer w0.305: U12.16 44.5,36.41 43.65,35.56 v1(43.65,32.13) ; U2.3 54.2,13.07 v1(53.3,13.97)
  Inner1 w0.305: v1(43.65,32.13) 43.77,32 47.71,32 49.23,30.48 49.23,18.41 51.14,16.51 52.79,16.51 53.3,16 v1(53.3,13.97)
SERVO1: length 37.3
  Top Layer w0.305: v1(44.41,32.64) 44.41,35.18 46.5,37.27 U12.17
  Inner1 w0.305: v1(54.19,14.22) 54.19,16.38 53.42,17.14 51.27,17.14 49.74,18.67 49.74,30.99 48.09,32.64 v1(44.41,32.64)
  Bottom Layer w0.305: v1(54.19,14.22) U3.1
SL_B_1: length 36.9
  Top Layer w0.305: U15.39 69.61,36.65 71.08,35.18 71.08,32.61 70.6,32.13 70.6,32.03 v1(70.44,31.88) ; R33.2 v1(64.6,32.13)
  Inner1 w0.305: v1(63.17,20.04) 63.2,20.01 63.2,19.05 62.82,18.67 60.79,18.67 60.18,19.28 60.18,23.96 61.81,25.59 61.79,25.64 61.81,25.65 61.81,30.23 62.44,30.86 64.35,30.86 64.6,31.11 v1(64.6,32.13) 65.24,31.5 66.25,31.5 66.63,31.88 v1(70.44,31.88)
  vias: v1(61.33,23.02) v1(61.37,21.93) v1(61.43,20.65) v1(61.68,22.48) v1(61.64,21.33) v1(61.77,20.05) v1(61.99,23.03) v1(62.06,21.93) v1(62.09,20.66) v1(62.27,21.34) v1(62.33,22.49) v1(62.46,20.02) v1(62.62,23.03) v1(62.71,21.9) v1(62.75,20.64) v1(62.97,22.49) v1(62.9,21.28) v1(63.27,23.04) v1(63.33,21.89) v1(63.43,20.63) v1(63.58,22.5) v1(63.55,21.27)
SL_B_2: length 39.4
  Top Layer w0.305: v1(25.87,31.88) R35.2 ; U16.39 27.24,38.12 30.06,35.31 30.95,35.31 31.33,34.92 v1(31.33,31.88)
  Inner1 w0.305: v1(31.33,31.88) 30.56,31.11 26.75,31.11 25.99,31.88 v1(25.87,31.88) 25.87,30.99 26.35,30.51 29.02,30.51 29.32,30.2 29.32,19.66 30.31,18.67 33.1,18.67 34,19.56 v1(34,20.03)
  vias: v1(32.16,23) v1(32.2,21.91) v1(32.26,20.64) v1(32.47,21.32) v1(32.51,22.46) v1(32.59,20.04) v1(32.82,23.02) v1(32.89,21.91) v1(32.92,20.65) v1(33.16,22.48) v1(33.1,21.33) v1(33.29,20.01) v1(33.45,23.02) v1(33.54,21.89) v1(33.58,20.63) v1(33.73,21.27) v1(33.8,22.48) v1(34.09,23.03) v1(34.16,21.88) v1(34.26,20.62) v1(34.37,21.26) v1(34.41,22.49)
